# EasyEDA Pro project 第十五届蓝桥杯EDA赛项模拟试题二（嘉立创EDA提供）.eprj, board PCB-PockerMultimater1
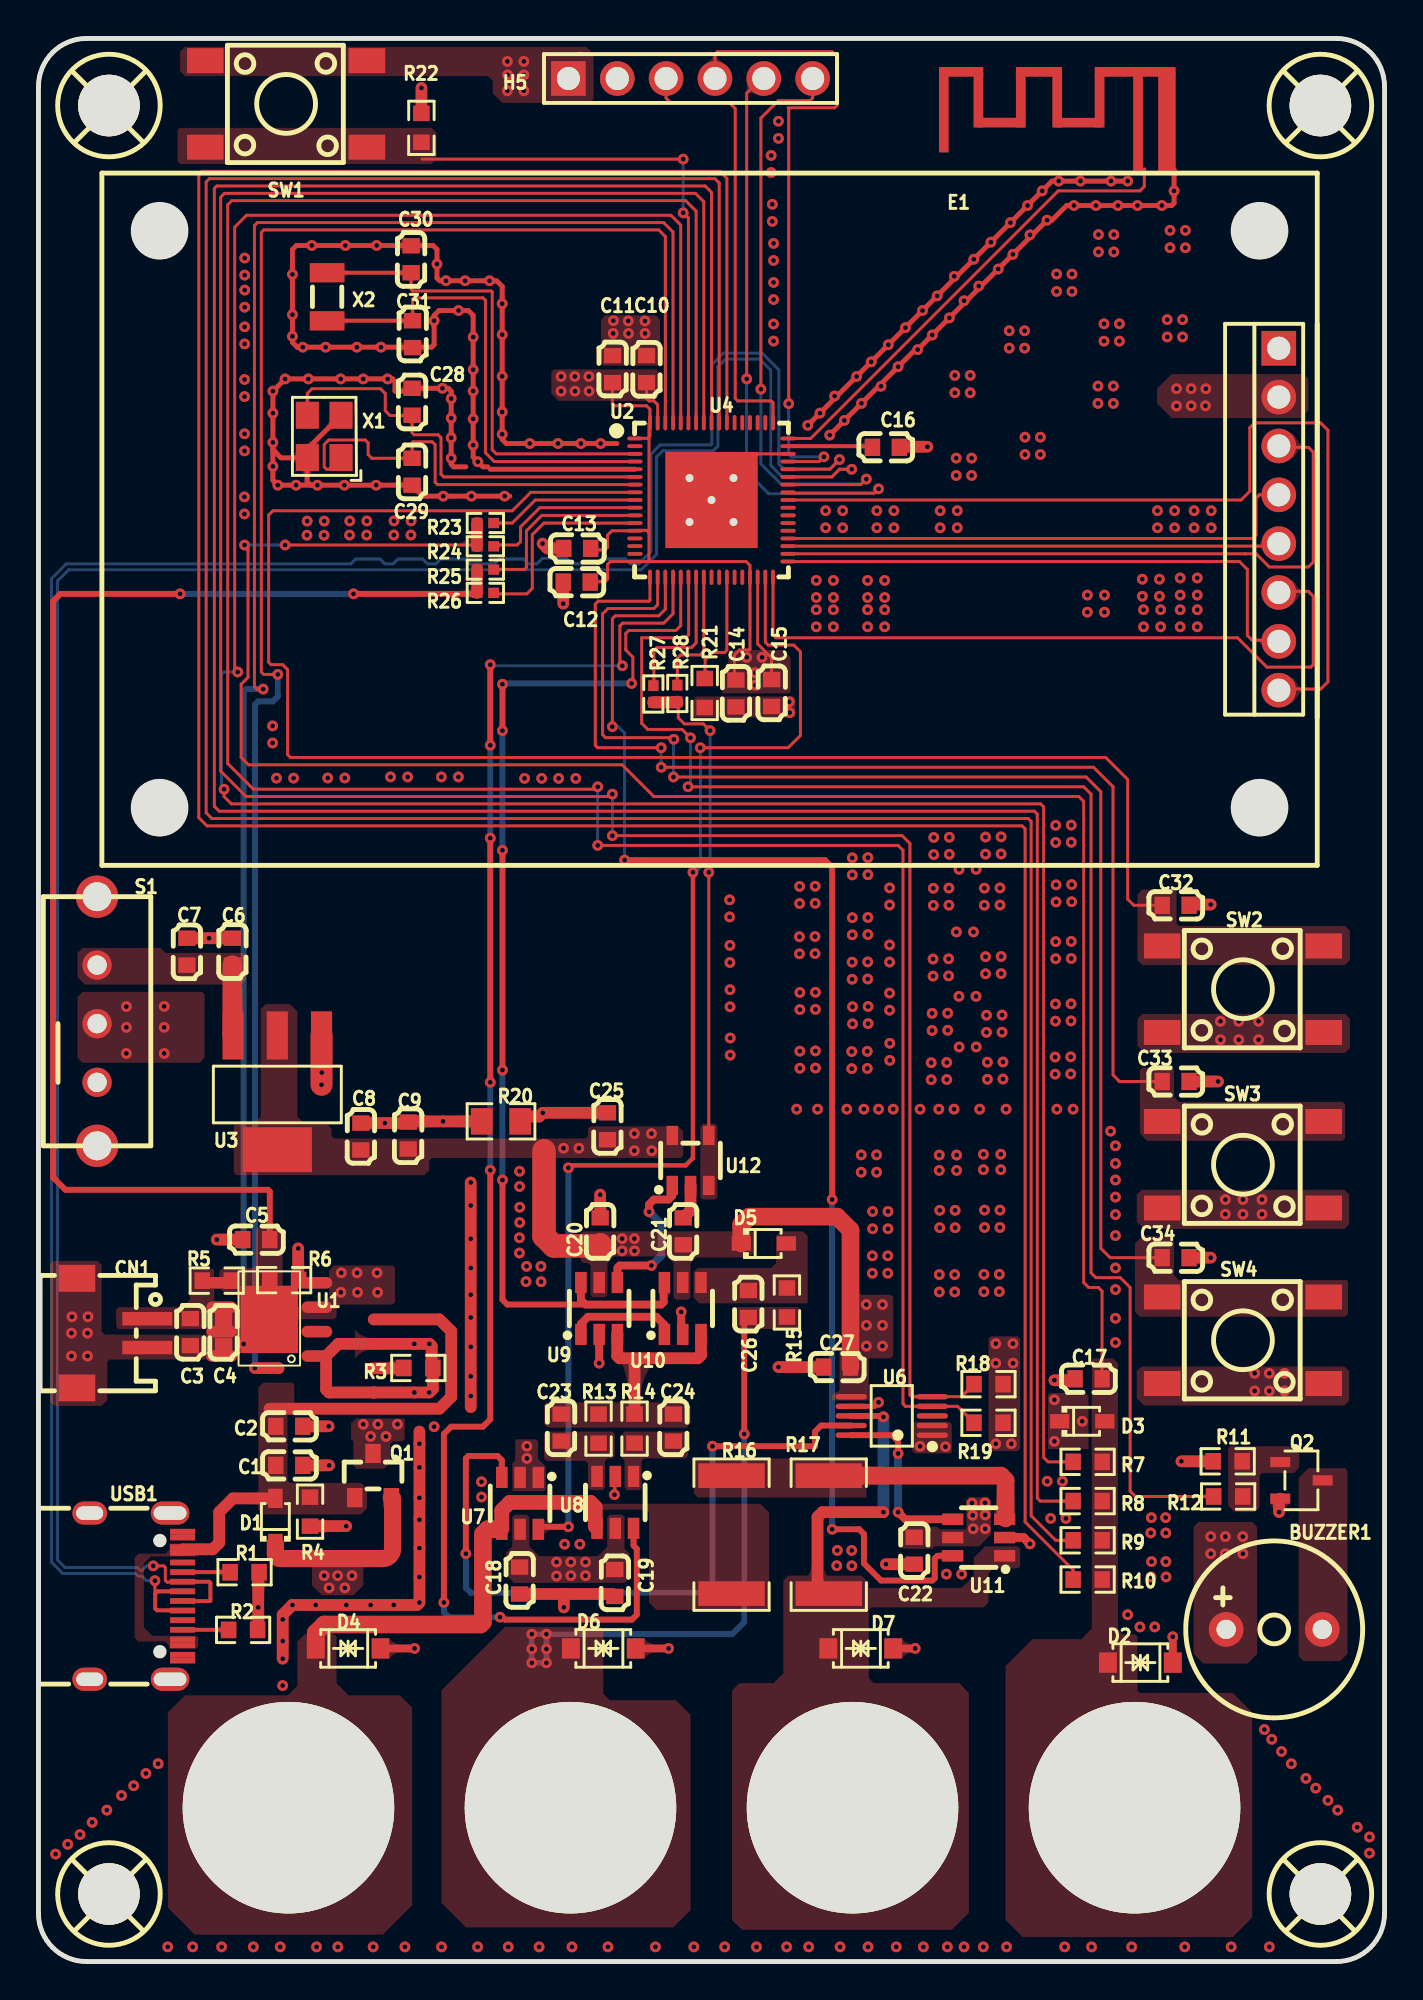
[diagram p1: board, top side]
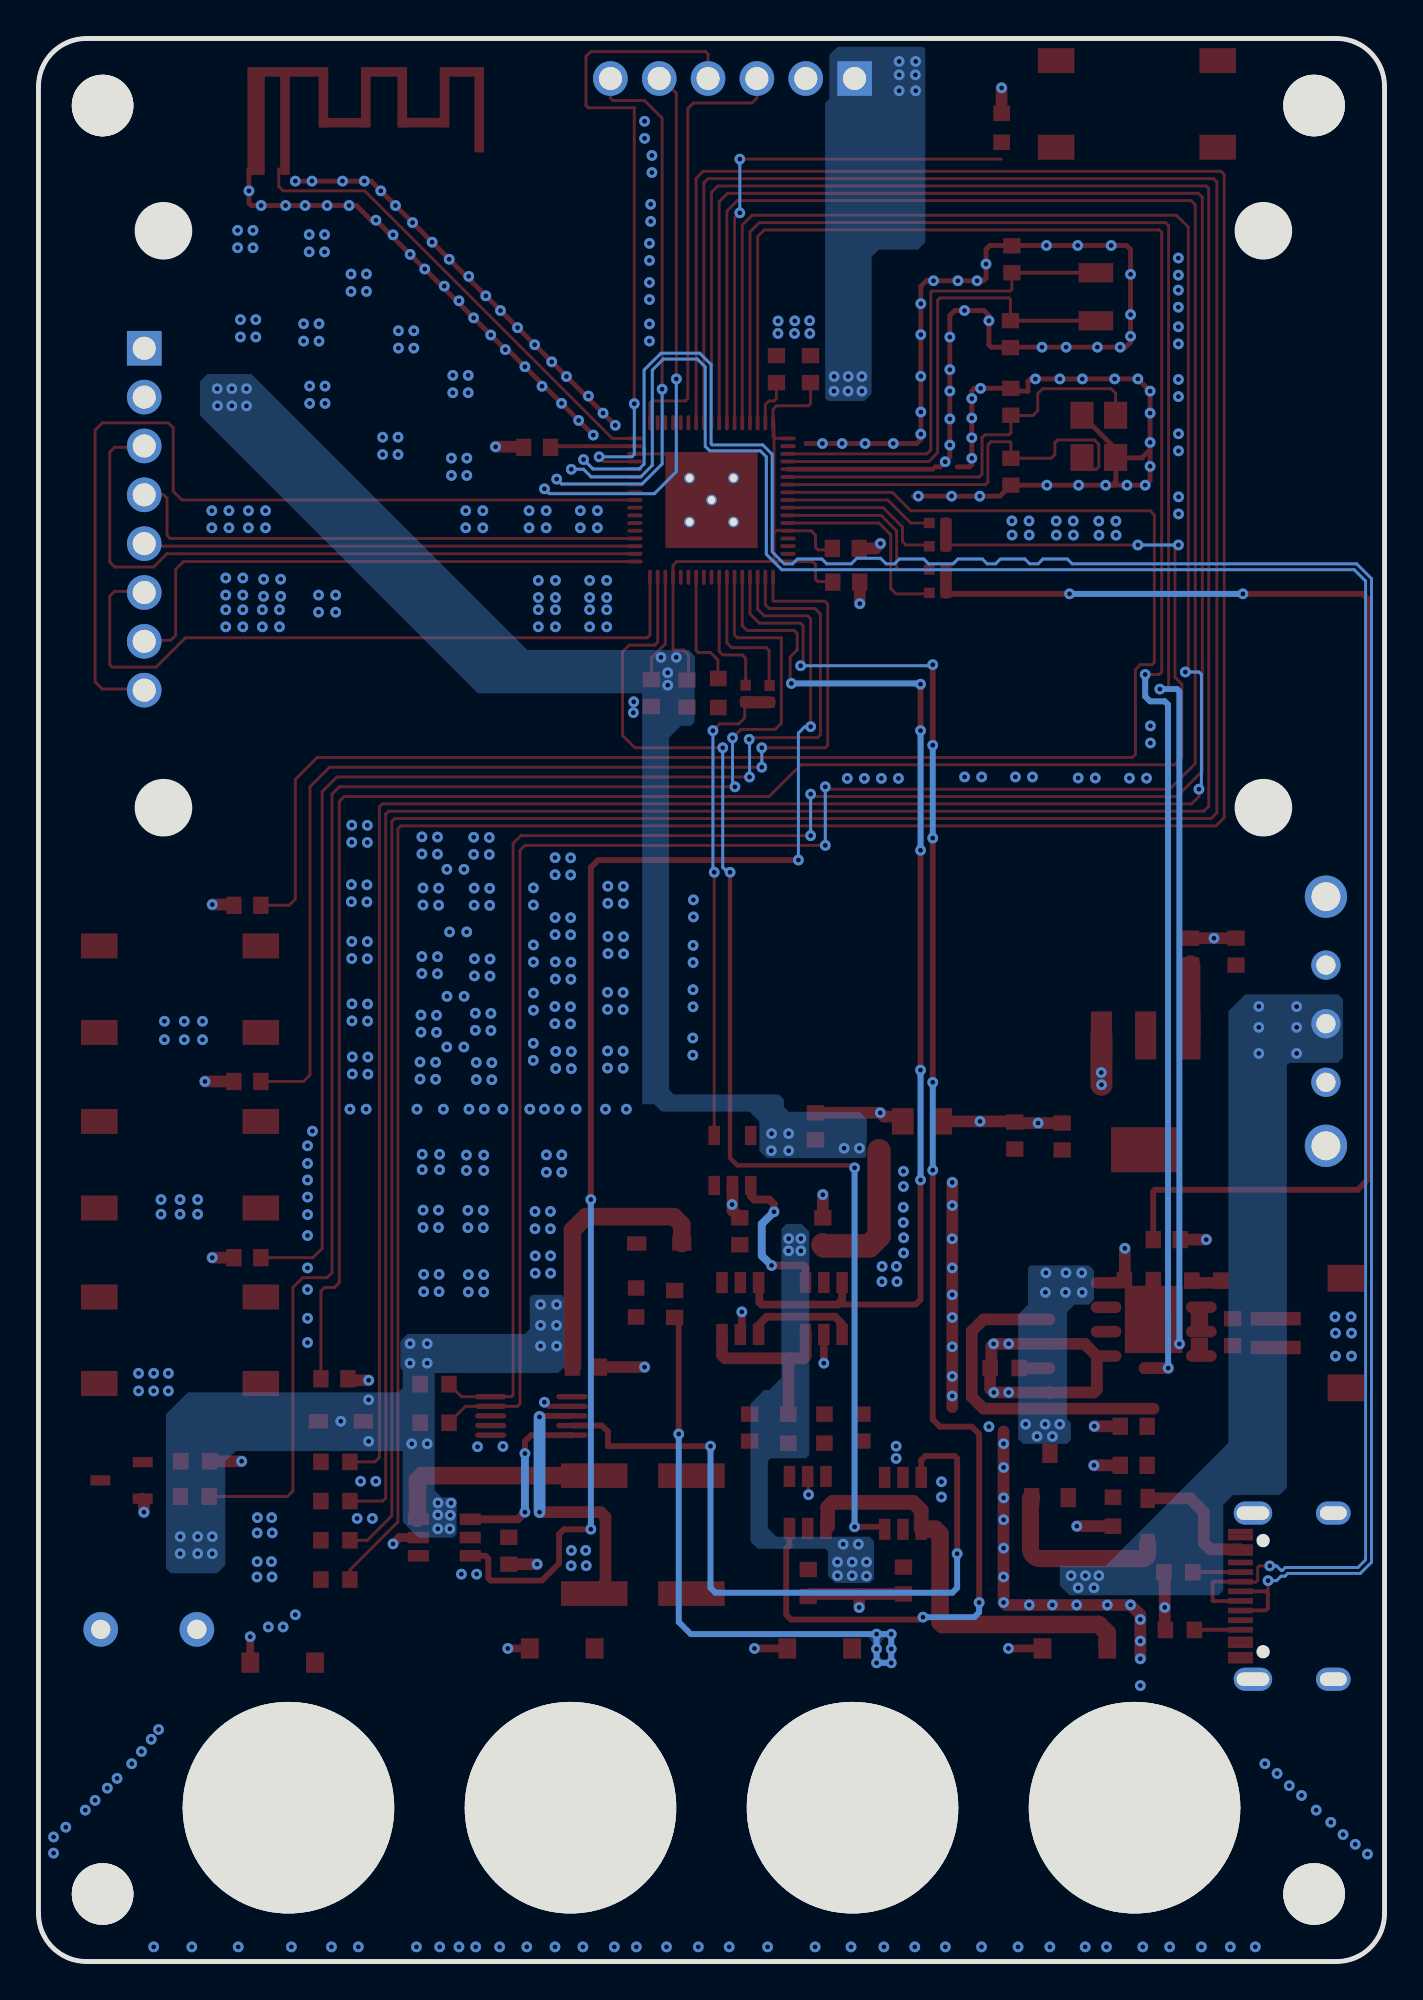
[diagram p2: board, bottom side, seen from below]

Outline 70 x 100 mm; copper layers: Top Layer, Bottom Layer. Coordinates in mm from the lower left corner of the outline.
Outline path: 0,97.5 0,2.5 arc(0.73,0.73) 2.5,0 67.5,0 arc(69.27,0.73) 70,2.5 70,97.5 arc(69.27,99.27) 67.5,100 2.5,100 arc(0.73,99.27) 0,97.5
Stack: Top Layer 0.035mm / Dielectric1 1.51mm FR4 er 4.5 / Bottom Layer 0.035mm

## Design rules (mm)
net USB1DM: DP4
net USB1DP: DP4
net OSC32IN: DP1
net OSC32OUT: DP1
net OSC_IN: DP3
net OSC_OUT: DP3
template: 自定义配置
spacing copperThickness1oz (default): track to track 0.152, other pairs 0.152 to 0.3
spacing copperThickness2oz: track to track 0.203, other pairs 0.152 to 0.3
spacing ANT: track to track 0.152, other pairs 0 to 0.3
track width copperThickness1oz (default): min 0.127, default 0.152, max 2.54
track width copperThickness2oz: min 0.203, default 0.254, max 2.54
track width PWR: min 0.152, default 0.61, max 2.54
differential pair differentialPair (default): width min 0.127, default 0.254, max 2.54; gap min 0.152, default 0.152
via viaSize (default): diameter min 0.5, default 0.559, max 10; hole min 0.254, default 0.254, max 6.299
net VIN uses PWR
net GND uses PWR
net VBUS uses PWR
net 3V3 uses PWR
net VINTA uses PWR
net VBAT uses PWR

## Placement (name value [footprint] x y rotation side)
BUZZER1  3kHz  [BUZ-TH_BD9.0-P5.00-D0.6-FD]  64.26 17.27 0 top
C1  10uF  [C0603]  13.05 25.8 180 top
C2  100nF  [C0603]  13.05 27.83 180 top
C3  10uF  [C0603]  7.9 32.73 90 top
C4  100nF  [C0603]  9.63 32.73 90 top
C5  100nF  [C0603]  11.33 37.54 180 top
C6  10uF  [C0603]  10.08 52.51 270 top
C7  100nF  [C0603]  7.72 52.51 90 top
C8  10uF  [C0603]  16.76 42.9 270 top
C9  100nF  [C0603]  19.23 42.95 90 top
C10  100nF  [C0603]  31.62 82.8 90 top
C11  100nF  [C0603]  29.85 82.8 270 top
C12  100nF  [C0603]  27.99 71.73 180 top
C13  100nF  [C0603]  28.02 73.48 180 top
C14  100nF  [C0603]  36.27 65.94 270 top
C15  100nF  [C0603]  38.13 65.96 270 top
C16  1uF  [C0603]  44.07 78.74 0 top
C17  100nF  [C0603]  54.61 30.3 0 top
C18  100nF  [C0603]  25.02 19.81 270 top
C19  100nF  [C0603]  29.97 19.69 270 top
C20  100nF  [C0603]  29.21 37.97 90 top
C21  100nF  [C0603]  33.53 37.97 90 top
C22  100nF  [C0603]  45.54 21.36 270 top
C23  100nF  [C0603]  27.18 27.77 90 top
C24  100nF  [C0603]  33.02 27.77 90 top
C25  100nF  [C0603]  29.59 43.43 90 top
C26  100nF  [C0603]  36.92 34.19 90 top
C27  100nF  [C0603]  41.53 30.91 180 top
C28  12pF  [C0603]  19.43 81.11 90 top
C29  12pF  [C0603]  19.43 77.47 90 top
C30  12pF  [C0603]  19.38 88.52 90 top
C31  12pF  [C0603]  19.46 84.62 270 top
C32  100nF  [C0603]  59.14 54.93 180 top
C33  100nF  [C0603]  59.14 45.76 180 top
C34  100nF  [C0603]  59.14 36.6 180 top
CN1  1.5K-BH-2PWB  [CONN-SMD_2P-P1.50_HDGC_1.5K-BH-2PWB]  3.84 32.68 270 top
D1  1N5819WS  [SOD-323_L1.8-W1.3-LS2.5-RD]  12.32 22.91 90 top
D2  SJD12C40L01  [SOD-123_L2.8-W1.8-LS3.7-BI]  57.3 15.54 180 top
D3  1N4148  [SOD-323_L1.8-W1.3-LS2.5-RD]  54.28 28.09 0 top
D4  SJD12C40L01  [SOD-123_L2.8-W1.8-LS3.7-BI]  16.1 16.28 180 top
D5  1N4148  [SOD-323_L1.8-W1.3-LS2.5-RD]  37.72 37.34 0 top
D6  SJD12C40L01  [SOD-123_L2.8-W1.8-LS3.7-BI]  29.37 16.28 180 top
D7  SJD12C40L01  [SOD-123_L2.8-W1.8-LS3.7-BI]  42.76 16.28 180 top
E1  d62bb7b376ef4f1495932ffa50be4b9b  [ANT-F-1-2.4G-1.6]  57.53 93.22 0 top
H1  -  [M3]  3.5 96.5 0 top
H2  -  [M3]  66.5 96.5 0 top
H3  -  [M3]  3.5 3.5 0 top
H4  -  [M3]  66.5 3.5 0 top
H5  2.54-1x6P直针  [HDR-TH_6P-P2.54-V-M-1]  33.91 97.92 0 top
J1  -  [香蕉头-4mm-24.302.*]  13 8 0 top
J2  -  [香蕉头-4mm-24.302.*]  27.67 8 0 top
J3  -  [香蕉头-4mm-24.302.*]  42.33 8 0 top
J4  -  [香蕉头-4mm-24.302.*]  57 8 0 top
Q1  AO3401A  [SOT-23_L2.9-W1.3-P1.90-LS2.4-BR]  17.4 25.27 270 top
Q2  S8050  [SOT-23-3_L3.0-W1.7-P0.95-LS2.9-BR]  65.68 25.02 180 top
R1  5.1kΩ  [R0603]  10.72 20.24 180 top
R2  5.1kΩ  [R0603]  10.64 17.25 180 top
R3  10kΩ  [R0603]  19.75 30.87 180 top
R4  10kΩ  [R0603]  14.12 23.39 90 top
R5  10kΩ  [R0603]  9.27 35.41 180 top
R6  10kΩ  [R0603]  12.78 35.43 180 top
R7  1kΩ  [R0603]  54.56 25.98 180 top
R8  10kΩ  [R0603]  54.56 23.94 180 top
R9  100kΩ  [R0603]  54.56 21.9 180 top
R10  1MΩ  [R0603]  54.56 19.86 180 top
R11  10kΩ  [R0603]  61.84 26.01 180 top
R12  10kΩ  [R0603]  61.87 24.18 180 top
R13  100kΩ  [R0603]  29.13 27.71 90 top
R14  1MΩ  [R0603]  31 27.71 90 top
R15  1MΩ  [R0603]  38.92 34.27 90 top
R16  10mΩ  [R2512]  36.04 22.2 270 top
R17  80mΩ  [R2512]  41.1 22.2 90 top
R18  4.7kΩ  [R0603]  49.4 30.02 0 top
R19  4.7kΩ  [R0603]  49.4 28.02 0 top
R20  0Ω  [R0805]  24.05 43.69 180 top
R21  10kΩ  [R0603]  34.65 65.96 270 top
R22  10kΩ  [R0603]  19.91 95.35 90 top
R23  0Ω  [R0402]  23.24 74.8 0 top
R24  0Ω  [R0402]  23.24 73.59 0 top
R25  0Ω  [R0402]  23.24 72.38 0 top
R26  0Ω  [R0402]  23.24 71.17 0 top
R27  0Ω  [R0402]  31.98 65.91 90 top
R28  0Ω  [R0402]  33.22 65.94 90 top
S1  SK-12E12-G5  [SW-TH_SK-12E12-G5]  3.05 48.89 180 top
SW1  TS-1002S-07026C  [KEY-SMD_4P-L6.0-W6.0-P4.50-LS9.0]  12.88 96.6 0 top
SW2  TS-1002S-07026C  [KEY-SMD_4P-L6.0-W6.0-P4.50-LS9.0]  62.64 50.56 0 top
SW3  TS-1002S-07026C  [KEY-SMD_4P-L6.0-W6.0-P4.50-LS9.0]  62.64 41.43 0 top
SW4  TS-1002S-07026C  [KEY-SMD_4P-L6.0-W6.0-P4.50-LS9.0]  62.64 32.31 0 top
U1  TP4056X-42-ESOP8  [TP4056-SOP8]  14.96 31.49 0 top
U2  -  [2.0寸TFT屏幕模块-8Pin]  35 75 270 top
U3  AMS1117-3.3  [SOT-223-3_L6.5-W3.4-P2.30-LS7.0-BR]  12.42 45.19 90 top
U4  7693da239a7c4f18baa0651e8e27e4a9  [QFN68(8x8)]  35 76 270 top
U6  INA226AIDGSR  [MSOP-10_L3.0-W3.0-P0.50-LS5.0-BL]  44.37 28.37 90 top
U7  SN74LVC1G3157DBVR  [SOT-23-6_L2.9-W1.6-P0.95-LS2.8-BR]  25.04 23.82 90 top
U8  SN74LVC1G3157DBVR  [SOT-23-6_L2.9-W1.6-P0.95-LS2.8-BR]  30 23.88 90 top
U9  SN74LVC1G3157DBVR  [SOT-23-6_L2.9-W1.6-P0.95-LS2.8-BR]  29.16 33.96 270 top
U10  SN74LVC1G3157DBVR  [SOT-23-6_L2.9-W1.6-P0.95-LS2.8-BR]  33.5 33.96 270 top
U11  SN74LVC1G3157DBVR  [SOT-23-6_L2.9-W1.6-P0.95-LS2.8-BR]  48.9 22.05 0 top
U12  LMV321IDBVR  [SOT-23-5_L3.0-W1.7-P0.95-LS2.8-BR]  33.91 41.66 270 top
USB1  KH-TYPE-C-16P  [USB-C-SMD_KH-TYPE-C-16P]  5.08 19 270 top
X1  32MHz  [OSC-SMD_4P-L3.2-W2.5-BL]  14.86 79.31 90 top
X2  32.768kHz  [FC-135R_L3.2-W1.5]  15.01 86.57 90 top

## Footprints (pads in the part's own frame, mm; a bottom-side part is the same pattern mirrored in y, then rotated)
2.0寸TFT屏幕模块-8Pin
  rect 1.8x1.8 hole 1.2: 1(-8.89,29.5)
  round 1.8 hole 1.2: 2(-6.35,29.5) 3(-3.81,29.5) 4(-1.27,29.5) 5(1.27,29.5) 6(3.81,29.5) 7(6.35,29.5) 8(8.89,29.5)
ANT-F-1-2.4G-1.6
  rect 0.8x0.6 smd: 0(1.143,0)
  rect 0.4x0.6 smd: 1(-0.34,0)
BUZ-TH_BD9.0-P5.00-D0.6-FD
  round 1.8 hole 1: 1(-2.5,0) 2(2.5,0)
C0603
  rect 0.8x0.9 smd: 1(-0.7,0) 2(0.7,0)
CONN-SMD_2P-P1.50_HDGC_1.5K-BH-2PWB
  rect 0.7x2.6 smd: 1(-0.75,1.825) 2(0.75,1.825)
  rect 1.4x1.9 smd: 3(2.85,-1.825) 4(-2.85,-1.825)
FC-135R_L3.2-W1.5
  rect 1x1.8 smd: 1(-1.25,0) 2(1.25,0)
HDR-TH_6P-P2.54-V-M-1
  rect 1.8x1.8 hole 1.2: 1(-6.35,0)
  round 1.8 hole 1.2: 2(-3.81,0) 3(-1.27,0) 4(1.27,0) 5(3.81,0) 6(6.35,0)
KEY-SMD_4P-L6.0-W6.0-P4.50-LS9.0
  rect 1.9x1.3 smd: 1(-4.2,2.25) 2(4.2,2.25) 3(-4.2,-2.25) 4(4.2,-2.25)
M3
  round 3.2 hole 3.2: 0(0.165,0.013)
MSOP-10_L3.0-W3.0-P0.50-LS5.0-BL
  oval 0.28x1.62 smd: 1(-1,-2.11) 2(-0.5,-2.11) 3(0,-2.11) 4(0.5,-2.11) 5(1,-2.11) 6(1,2.11) 7(0.5,2.11) 8(0,2.11) 9(-0.5,2.11) 10(-1,2.11)
OSC-SMD_4P-L3.2-W2.5-BL
  rect 1.4x1.2 smd: 1(-1.1,-0.875) 2(1.1,-0.875) 3(1.1,0.875) 4(-1.1,0.875)
QFN68(8x8)
  round 0.559 hole 0.406: 0(-1.143,1.143) 0(-1.143,-1.143) 0(0,0) 0(1.143,1.143) 0(1.143,-1.143)
  rect 5x4.8 smd: 0(0,0)
  oval 0.2x0.8 smd: 1(-3.2,-3.982) 2(-2.8,-3.982) 3(-2.4,-3.982) 4(-2,-3.982) 5(-1.6,-3.982) 6(-1.2,-3.982) 7(-0.8,-3.982) 8(-0.4,-3.982) 9(0,-3.982) 10(0.4,-3.982) 11(0.8,-3.982) 12(1.2,-3.982) 13(1.6,-3.982) 14(2,-3.982) 15(2.4,-3.982) 16(2.8,-3.982) 17(3.2,-3.982) 35(3.2,3.982) 36(2.8,3.982) 37(2.4,3.982) 38(2,3.982) 39(1.6,3.982) 40(1.2,3.982) 41(0.8,3.982) 42(0.4,3.982) 43(0,3.982) 44(-0.4,3.982) 45(-0.8,3.982) 46(-1.2,3.982) 47(-1.6,3.982) 48(-2,3.982) 49(-2.4,3.982) 50(-2.8,3.982) 51(-3.2,3.982)
  oval 0.8x0.2 smd: 18(4.018,-3.2) 19(4.018,-2.8) 20(4.018,-2.4) 21(4.018,-2) 22(4.018,-1.6) 23(4.018,-1.2) 24(4.018,-0.8) 25(4.018,-0.4) 26(4.018,0) 27(4.018,0.4) 28(4.018,0.8) 29(4.018,1.2) 30(4.018,1.6) 31(4.018,2) 32(4.018,2.4) 33(4.018,2.8) 34(4.018,3.2) 52(-4.018,3.2) 53(-4.018,2.8) 54(-4.018,2.4) 55(-4.018,2) 56(-4.018,1.6) 57(-4.018,1.2) 58(-4.018,0.8) 59(-4.018,0.4) 60(-4.018,0) 61(-4.018,-0.4) 62(-4.018,-0.8) 63(-4.018,-1.2) 64(-4.018,-1.6) 65(-4.018,-2) 66(-4.018,-2.4) 67(-4.018,-2.8) 68(-4.018,-3.2)
R0402
  rect 0.566x0.54 smd: 1(-0.433,0) 2(0.433,0)
R0603
  rect 0.806x0.864 smd: 1(-0.753,0) 2(0.753,0)
R0805
  rect 1.133x1.377 smd: 1(-1,0) 2(1,0)
R2512
  rect 1.282x3.456 smd: 1(-3.067,0) 2(3.067,0)
SOD-123_L2.8-W1.8-LS3.7-BI
  rect 0.93x1.06 smd: 1(1.685,0) 2(-1.685,0)
SOD-323_L1.8-W1.3-LS2.5-RD
  rect 1x0.75 smd: 1(-1.173,0) 2(1.173,0)
SOT-23-3_L3.0-W1.7-P0.95-LS2.9-BR
  rect 1.038x0.532 smd: 1(1.101,-0.95) 2(1.101,0.95) 3(-1.101,0)
SOT-23-5_L3.0-W1.7-P0.95-LS2.8-BR
  rect 1x0.6 smd: 1(1.3,-0.95) 2(1.3,0) 3(1.3,0.95) 4(-1.3,0.95) 5(-1.3,-0.95)
SOT-23-6_L2.9-W1.6-P0.95-LS2.8-BR
  rect 1.1x0.6 smd: 1(1.35,-0.95) 2(1.35,0) 3(1.35,0.95) 4(-1.35,0.95) 5(-1.35,0) 6(-1.35,-0.95)
SOT-23_L2.9-W1.3-P1.90-LS2.4-BR
  rect 1x0.8 smd: 1(1.15,-0.95) 2(1.15,0.95) 3(-1.15,0)
SOT-223-3_L6.5-W3.4-P2.30-LS7.0-BR
  rect 2.5x1.1 smd: 1(2.97,-2.3) 2(2.97,0) 3(2.97,2.3)
  rect 2.34x3.6 smd: 4(-2.97,0)
SW-TH_SK-12E12-G5
  round 1.524 hole 1: 1(0,3.175) 2(0,0.127) 3(0,-2.921)
  round 2.2 hole 1.5: 4(0,-6.477) 5(0,6.477)
TP4056-SOP8
  oval 1.6x0.6 smd: 1(-0.48,0) 2(-0.48,1.27) 3(-0.48,2.54) 4(-0.48,3.81) 5(-5.43,3.81) 6(-5.43,2.54) 7(-5.43,1.27) 8(-5.43,0)
  rect 3x3.5 smd: 9(-2.955,1.905)
USB-C-SMD_KH-TYPE-C-16P
  oval 1.2x2 hole 0.7x1.7: 1(-4.32,1.765) 2(4.32,1.765)
  oval 1.2x1.8 hole 0.7x1.4: 3(-4.32,-2.415) 4(4.32,-2.415)
  rect 0.3x1.3 smd: A1(-3.35,2.415) A4(-2.55,2.415) A5(-1.25,2.415) A6(-0.25,2.415) A7(0.25,2.415) A8(1.25,2.415) A9(2.55,2.415) A12(3.35,2.415) B1(3.05,2.415) B4(2.25,2.415) B5(1.75,2.415) B6(0.75,2.415) B7(-0.75,2.415) B8(-1.75,2.415) B9(-2.25,2.415) B12(-3.05,2.415)
香蕉头-4mm-24.302.*
  round 11 hole 12.2x6.1: 1(0,0)

## Nets
As in the schematic.

Pads without a net: E1 0; H1 0; H2 0; H3 0; H4 0; S1 1; U4 2 14 15 16 26 27 29 30 39 40 41 42 53 54 55 56 57; U6 3; USB1 A8 B8

## Via types
v1: diameter 0.559, hole 0.254, Top Layer to Bottom Layer, 768 vias

## Routing (per net, layer and track width the routed paths; a pad name or vN(x,y) marks a point on that pad's centre or on a via; arc(x,y) is an arc through that point)
3V3: length 62.4
  Top Layer w0.152: C13.1 28.79,73.41 29.46,73.41 29.59,73.53 29.59,74.17 29.82,74.4 U4.13 31.04,74.42 31.62,74.42 31.75,74.3 ; 31.75,74.3 31.75,79.29 ; 31.75,74.3 31.75,72.9 31.65,72.8 ; U4.1 31.02,79.21 31.67,79.21 31.75,79.29 ; U4.68 31.75,79.97 31.75,79.29 ; U4.68 31.8,79.34 31.75,79.29 ; U4.68 31.8,80.72 31.62,80.9 29.97,80.9 29.84,81.03 29.84,82.1 ; C10.1 31.62,81.28 31.75,81.15 32,81.15 32.2,80.96 U4.67 ; 31.65,72.8 U4.17 29.75,72.8 29.59,72.64 29.59,71.88 29.46,71.75 28.72,71.75 C12.1 ; 31.65,72.8 36.8,72.8 37,72.6 U4.31 37,68.24 36.96,68.2 36.45,68.2 36.19,67.94 36.19,66.71 C14.1 ; C15.1 38.13,67.79 37.4,68.52 U4.32
  Top Layer w0.914: D5.1 36.55,38.32 36.96,38.73 41.53,38.73 42.23,38.03 C27.1
  Top Layer w1.219: 26.29,42.16 26.29,37.72 26.8,37.21 29.15,37.21 C20.1
  vias: v1(24.38,98.81) v1(24.4,98.11) v1(24.38,97.28) v1(25.24,98.81) v1(25.24,98.11) v1(25.24,97.28) v1(26.94,20.77) v1(26.94,20.05) v1(27.18,82.42) v1(27.18,81.66) v1(27.31,42.29) v1(27.36,21.7) v1(27.69,20.77) v1(27.69,20.07) v1(27.89,82.42) v1(27.9,81.66) v1(28.1,42.29) v1(28.15,21.7) v1(28.45,20.77) v1(28.45,20.07) v1(28.62,82.42) v1(28.63,81.66) v1(30.35,37.59) v1(30.35,36.96) v1(30.99,43.05) v1(30.99,42.16) v1(30.99,37.59) v1(31,36.96) v1(31.88,43.05) v1(31.89,42.16) v1(36.83,67.82) v1(37.28,67.02) v1(37.28,66.37) v1(37.63,67.82) v1(43.05,34.16) v1(43.06,33.08) v1(43.05,32) v1(43.89,34.16) v1(43.89,33.08) v1(43.89,32) v1(48.54,23.84) v1(48.58,23.21) v1(48.61,22.5) v1(49.22,23.85) v1(49.23,23.22) v1(49.23,22.5) v1(49.78,32.13) v1(49.78,31.12) v1(49.78,26.92) v1(50.59,26.92) v1(50.68,32.13) v1(50.68,31.12) v1(52.83,29.21) v1(52.83,27.05) v1(54.28,28.09) v1(59.18,81.79) v1(59.18,80.89) v1(59.94,81.79) v1(59.94,80.9) v1(60.71,81.79) v1(60.69,80.9) v1(60.96,22.1) v1(60.96,21.21) v1(61.72,22.1) v1(61.72,21.21) v1(62.63,22.1) v1(62.63,21.21)
+5V: length 9.8
  Top Layer w0.889: D1.1 12.32,21.21 arc(12.39,21.03) 12.57,20.96 17.91,20.96 arc(18.27,21.1) 18.41,21.46 18.41,24.06 arc(18.4,24.1) Q1.2
  vias: v1(4.57,49.66) v1(4.57,48.58) v1(4.57,47.22) v1(6.54,49.67) v1(6.54,48.58) v1(6.54,47.22) v1(14.86,20.07) v1(15.11,19.43) v1(15.56,20.07) v1(15.93,19.43) v1(16.3,20.07)
AGND: length 60.9
  Top Layer w0.152: 29.97,25.11 29.97,24.34 29.96,24.34
  Top Layer w0.254: U6.7 43.48,28.87 v1(43.69,29.08)
  Top Layer w0.406: D6.2 v1(32.77,16.28) ; D7.2 v1(45.59,16.28) ; D2.2 v1(58.99,16.89) ; D4.2 v1(19.56,16.28) ; U9.2 v1(29.16,31.12) ; 33.42,32.75 v1(33.42,33.78)
  Top Layer w0.457: v1(51.56,21.72) 51.23,22.05 U11.2
  Top Layer w0.61: v1(12.7,15.75) v1(12.7,16.67) 12.7,18.03 v1(13.21,18.54) v1(14.42,18.54) v1(16.01,18.54) v1(17.27,18.54) v1(18.48,18.54) 19.69,18.54 v1(19.81,18.67) v1(19.81,20) v1(19.81,21.5) v1(19.81,22.97) v1(19.81,24.11) v1(19.81,25.69) v1(19.81,26.93) 19.81,27.56 ; C22.2 v1(44.07,20.66) ; R20.1 25.31,43.94 26.03,43.94 v1(26.23,44.13) C25.2 ; C20.2 v1(29.21,39.88) ; U12.2 33.91,39.05 C21.2 ; C18.2 27.32,19.11 ; 27.32,19.11 29.84,19.11 C19.2 ; 27.32,19.11 v1(27.32,18.41) ; 22.48,28.83 v1(22.48,29.41) v1(22.48,30.43) v1(22.48,31.97) v1(22.48,33.49) v1(22.48,34.67) v1(22.48,36.07) v1(22.48,37.58) v1(22.48,39.31) v1(22.48,40.51) ; v1(52.83,30.23) 53.83,30.23 C17.1 ; C27.2 v1(38.48,30.91)
  vias: v1(0.89,5.59) v1(1.52,6.1) v1(2.16,6.6) v1(2.79,7.24) v1(3.56,7.87) v1(4.32,8.64) v1(4.95,9.14) v1(5.59,9.78) v1(6.22,10.29) v1(6.72,0.76) v1(8.02,0.76) v1(9.52,0.76) v1(11.18,0.76) v1(12.57,0.76) v1(12.7,17.79) v1(12.7,14.35) v1(14.46,0.76) v1(15.57,0.76) v1(17.4,0.76) v1(19.06,0.76) v1(20.57,27.81) v1(20.96,0.76) v1(22.84,0.76) v1(23.04,24.95) v1(23.04,24.16) v1(24.43,0.76) v1(25.02,41.09) v1(25.02,40.3) v1(25.03,39.22) v1(25.03,38.43) v1(25.01,37.64) v1(25.01,36.84) v1(25.38,36.15) v1(25.35,35.36) v1(25.4,26.8) v1(25.4,26.16) v1(26.03,0.76) v1(26.13,36.15) v1(26.14,35.35) v1(27.74,0.76) v1(29.61,0.76) v1(29.95,24.28) v1(32.08,0.76) v1(33.93,39.36) v1(34.08,0.76) v1(35.69,0.76) v1(37.34,0.76) v1(38.91,0.76) v1(39.43,44.32) v1(40.05,0.76) v1(40.51,44.32) v1(41.54,21.38) v1(41.52,20.58) v1(41.69,0.76) v1(42.04,44.32) v1(42.29,21.38) v1(42.3,20.58) v1(42.78,41.95) v1(42.78,41.04) v1(42.92,44.32) v1(43.14,0.76) v1(43.38,39.01) v1(43.38,38.1) v1(43.37,36.7) v1(43.37,35.79) v1(43.59,41.95) v1(43.59,41.04) v1(43.69,44.32) v1(44.18,39.01) v1(44.18,38.1) v1(44.17,36.7) v1(44.17,35.79) v1(44.45,44.32) v1(44.61,0.76) v1(45.85,44.32) v1(45.85,26.79) v1(46.02,0.76) v1(46.82,44.32) v1(46.84,41.94) v1(46.84,41.14) v1(46.85,35.72) v1(46.85,34.82) v1(46.87,39.06) v1(46.87,38.16) v1(47.17,26.77) v1(47.21,20.14) v1(47.26,0.76) v1(47.61,44.32) v1(47.65,35.72) v1(47.65,34.82) v1(47.75,41.94) v1(47.75,41.14) v1(47.67,39.06) v1(47.67,38.16) v1(48.01,20.14) v1(48.13,0.76) v1(48.94,44.32) v1(49.14,41.98) v1(49.14,41.18) v1(49.13,0.76) v1(49.2,39.07) v1(49.2,38.17) v1(49.17,35.74) v1(49.17,34.83) v1(50.04,41.98) v1(50.04,41.18) v1(50,39.07) v1(50,38.17) v1(49.97,35.74) v1(49.97,34.83) v1(50.32,44.32) v1(50.35,0.76) v1(52.46,24.97) v1(52.64,23.04) v1(52.96,44.32) v1(53.25,24.97) v1(53.43,23.04) v1(53.37,0.76) v1(53.8,44.32) v1(54.76,0.76) v1(55.75,43.18) v1(56.01,42.42) v1(56.01,41.5) v1(56.01,40.64) v1(56.01,39.75) v1(56.01,38.84) v1(56.01,37.75) v1(56.01,36.07) v1(56.01,34.94) v1(56.01,33.45) v1(56.01,32.19) v1(56.64,18.03) v1(56.85,0.76) v1(57.28,17.4) v1(58.05,17.4) v1(59.61,0.76) v1(62.02,0.76) v1(63.75,12.06) v1(64.01,0.76) v1(64.13,11.56) v1(64.64,10.92) v1(65.15,10.29) v1(65.91,9.53) v1(66.42,9.02) v1(67.06,8.38) v1(67.56,7.87) v1(68.58,6.99) v1(69.22,6.48) v1(69.22,5.64)
GND: length 197.6
  Top Layer w0.152: U4.0 U4.0 37.4,78.4 U4.49 ; 23.49,77.6 23.37,77.72
  Top Layer w0.254: v1(56.64,92.58) v1(55.78,92.58) v1(54.19,92.58) v1(53.06,92.58) 52.71,92.58 v1(52.2,92.08) v1(51.44,91.31) v1(50.55,90.42) v1(49.53,89.41) v1(48.64,88.52) v1(46.74,86.61) v1(45.97,85.85) v1(45.09,84.96) v1(44.2,84.07) v1(43.31,83.19) v1(42.54,82.42) v1(40.64,80.52) v1(40,79.88) ; 12.19,78.61 v1(12.19,77.75) 12.19,77.02 v1(12.45,76.77) v1(13.4,76.77) 14.16,76.77 ; 12.19,78.61 v1(12.19,78.99) v1(12.19,80.52) v1(12.19,81.66) v1(12.83,82.3) v1(14.04,82.3) v1(15.72,82.3) v1(16.89,82.3) 18.41,82.3 18.54,82.17 18.54,81.66 19.28,81.66 C28.2 v1(21.01,81.81) 21.32,81.81 21.46,81.66 v1(21.46,81.28) v1(21.46,80.26) v1(21.46,79.23) v1(21.46,78.17) 21.46,77.85 21.59,77.72 22.22,77.72 ; 12.19,78.61 12.61,78.19 13.97,78.19 ; 19.43,83.95 C31.2 ; 19.43,83.95 v1(17.81,83.95) v1(16.56,83.95) v1(14.93,83.95) v1(13.75,83.95) 13.46,83.95 13.21,84.2 v1(13.21,84.51) v1(13.21,85.64) v1(13.21,87.73) 13.21,89.03 13.42,89.23 v1(14.22,89.23) v1(15.96,89.23) v1(17.58,89.23) 20.52,89.23 20.72,89.03 v1(20.72,88.27) 20.72,87.54 20.86,87.4 v1(21.19,87.4) v1(22.19,87.4) v1(23.46,87.4) 23.82,87.4 24.12,87.11 v1(24.12,86.21) v1(24.12,84.6) v1(24.12,82.43) v1(24.12,80.58) 24.12,79.15 24.33,78.94 v1(25.55,78.94) v1(27.01,78.94) v1(28.21,78.94) v1(29.23,78.94) 30.08,78.94 ; 19.43,83.95 20.45,83.95 20.57,84.07 20.57,85.6 20.83,85.85 v1(21.84,85.85) 22.35,85.85 22.61,85.6 v1(22.61,84.47) v1(22.61,82.78) v1(22.61,81.67) v1(22.61,80.22) v1(22.61,78.86) 22.61,78.23 v1(22.85,77.99) 23.11,77.72 23.37,77.72 ; 13.97,78.19 13.97,76.96 14.16,76.77 ; 13.97,78.19 X1.4 13.98,78.66 X1.2 ; 23.49,77.6 U4.5 ; 59.01,93.22 59.06,93.18 v1(59.06,92.08) 59.06,91.44 58.93,91.31 v1(58.42,91.31) v1(57.15,91.31) v1(56.13,91.31) v1(54.99,91.31) v1(53.85,91.31) 53.47,91.31 52.71,90.55 v1(52.45,90.55) v1(50.67,88.77) v1(49.91,88.01) v1(47.37,85.47) v1(46.48,84.58) v1(45.72,83.82) 45.59,83.82 v1(44.7,82.93) v1(42.8,81.03) v1(41.91,80.14) v1(41.15,79.38) ; 24.51,76.2 v1(22.51,76.2) v1(21.05,76.2) 20,76.2 C29.1 v1(17.56,76.77) v1(15.91,76.77) v1(14.5,76.77) 14.16,76.77